# EasyEDA Pro project Q's HelloWorld KeyBoard.eprj, schematic SCH 主体功能板

## Sheets
1 P1: Create Date: 2022-10-02; Page Name: P1; Project Name: Q's HelloWorld KeyBoard; Schematic Name: SCH 主体功能板; Update Date: 2022-10-06; Company: 嘉立创EDA; Page Size: A4; Version: V1.0
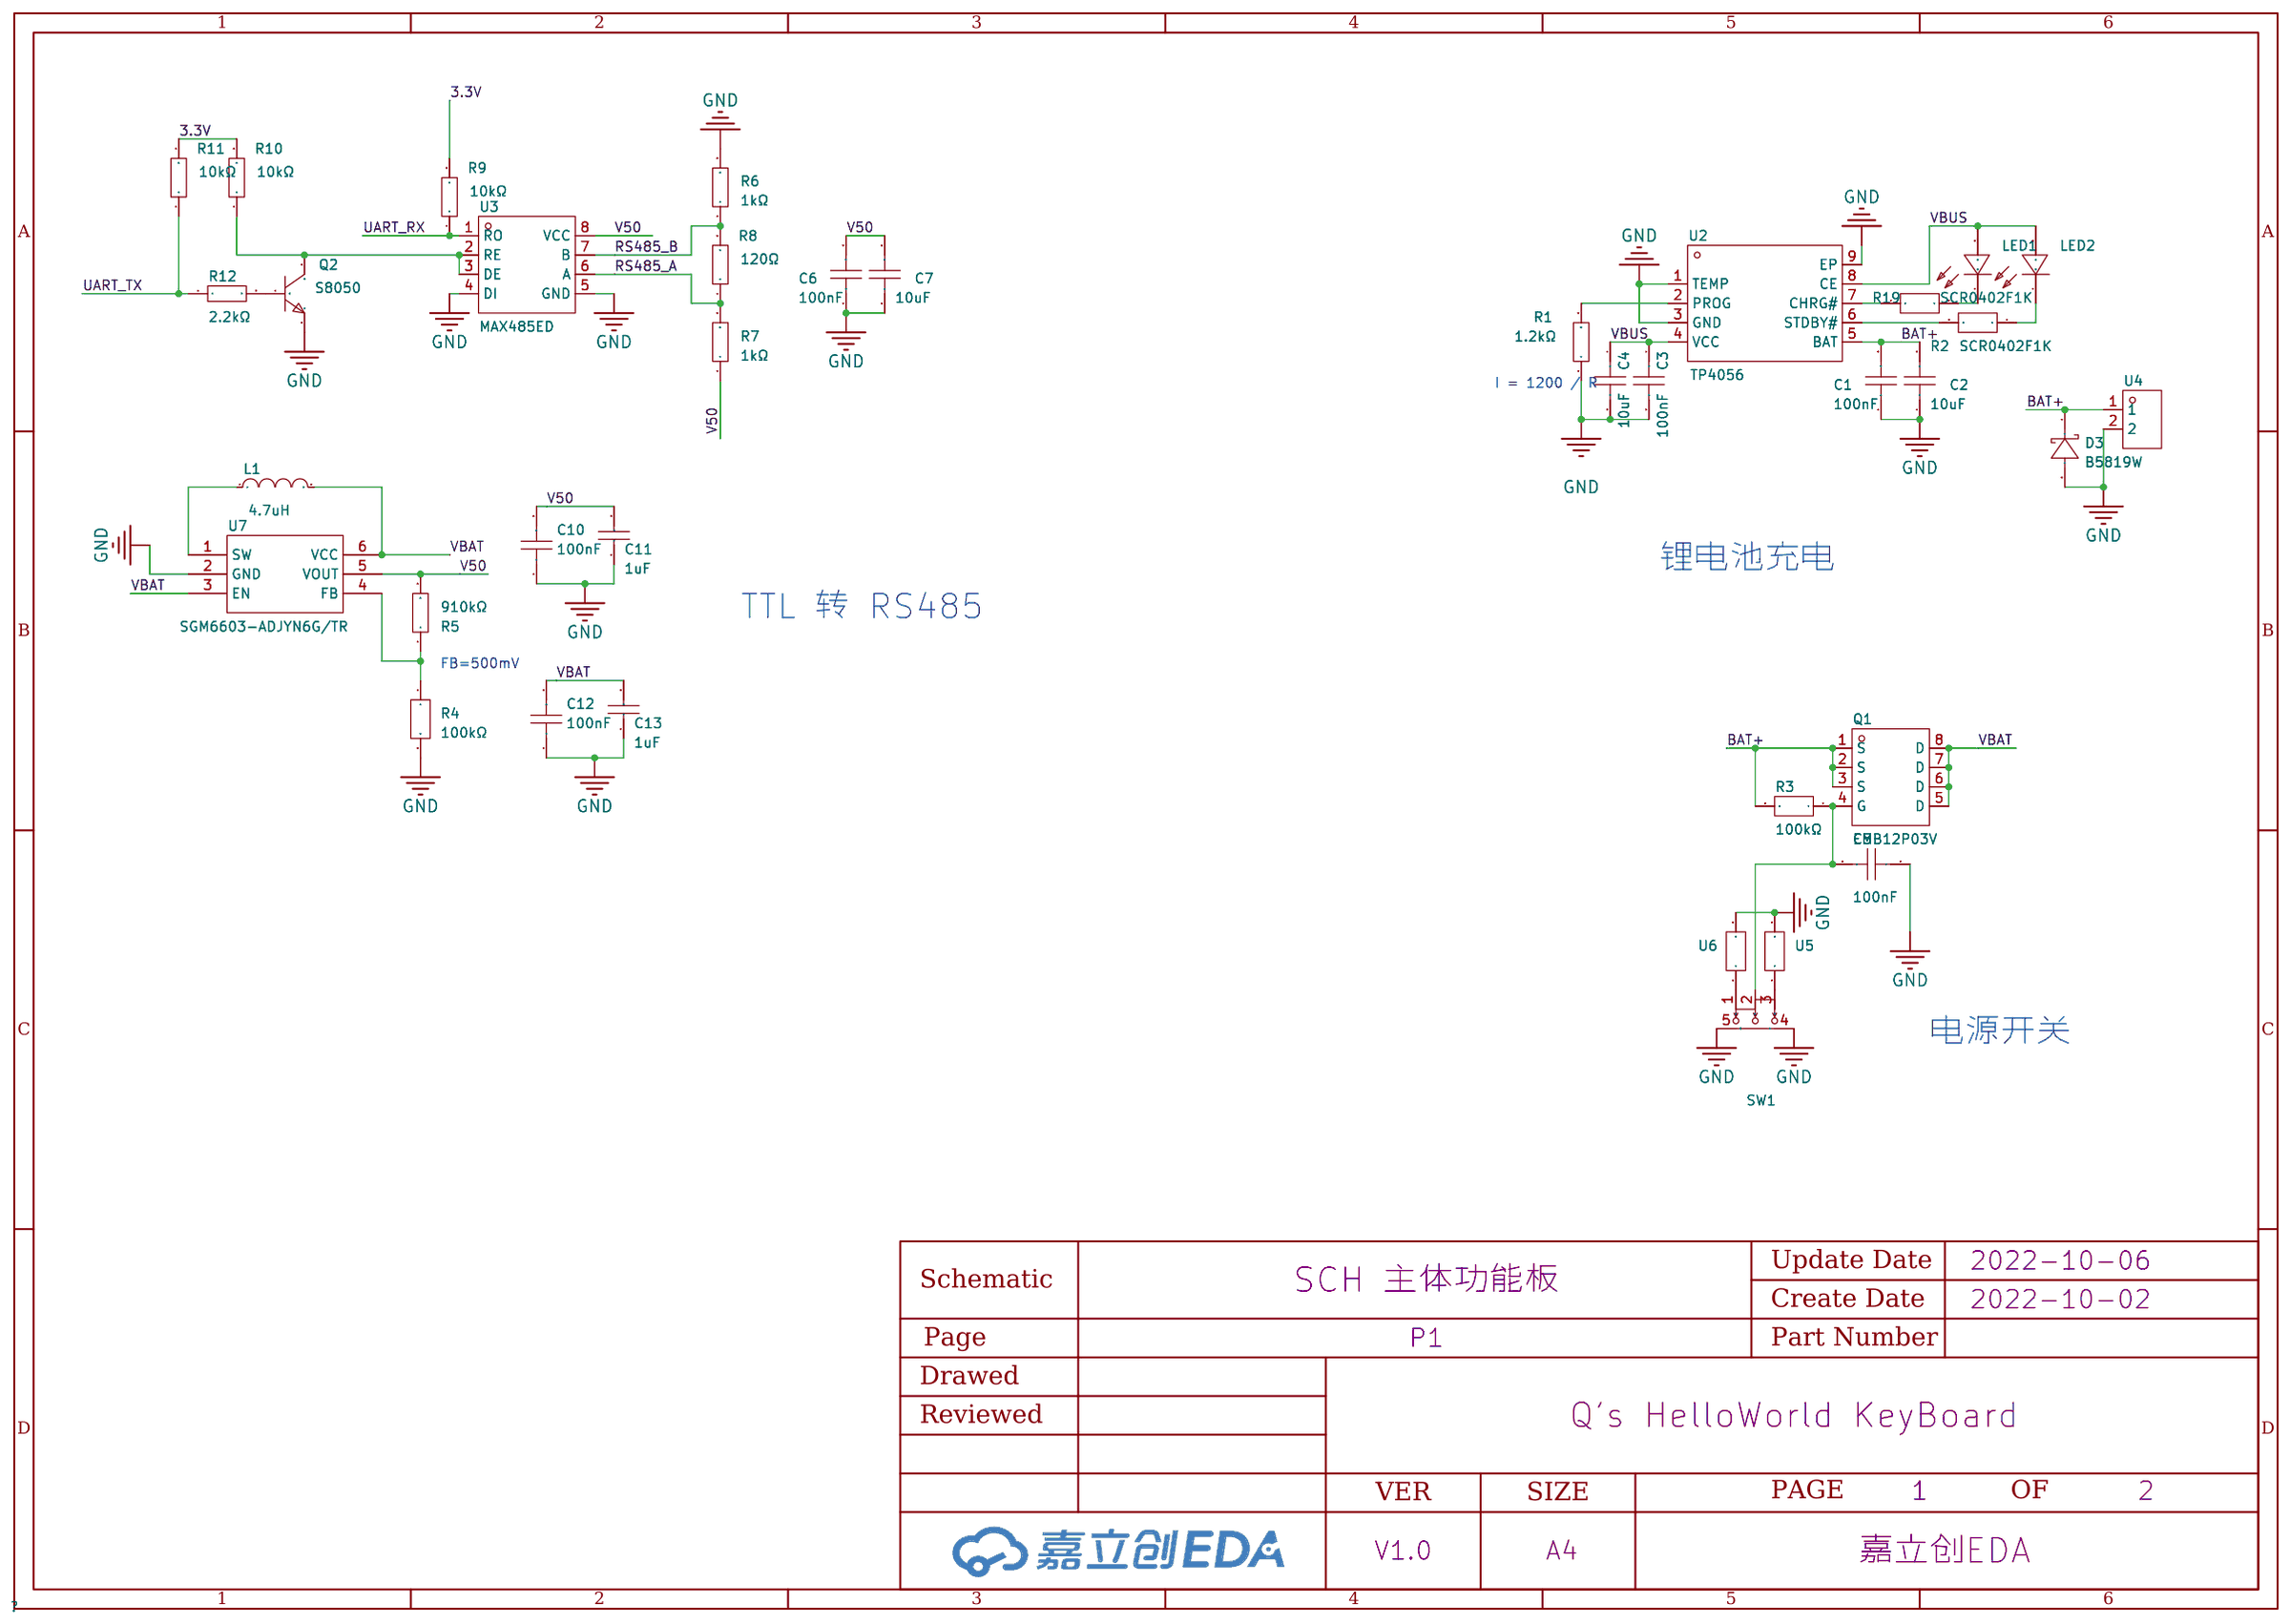
[diagram p2: P1]
2 P2 USB Hub: Page Name: P2 USB Hub; Update Date: 2022-10-05; Page Size: A3
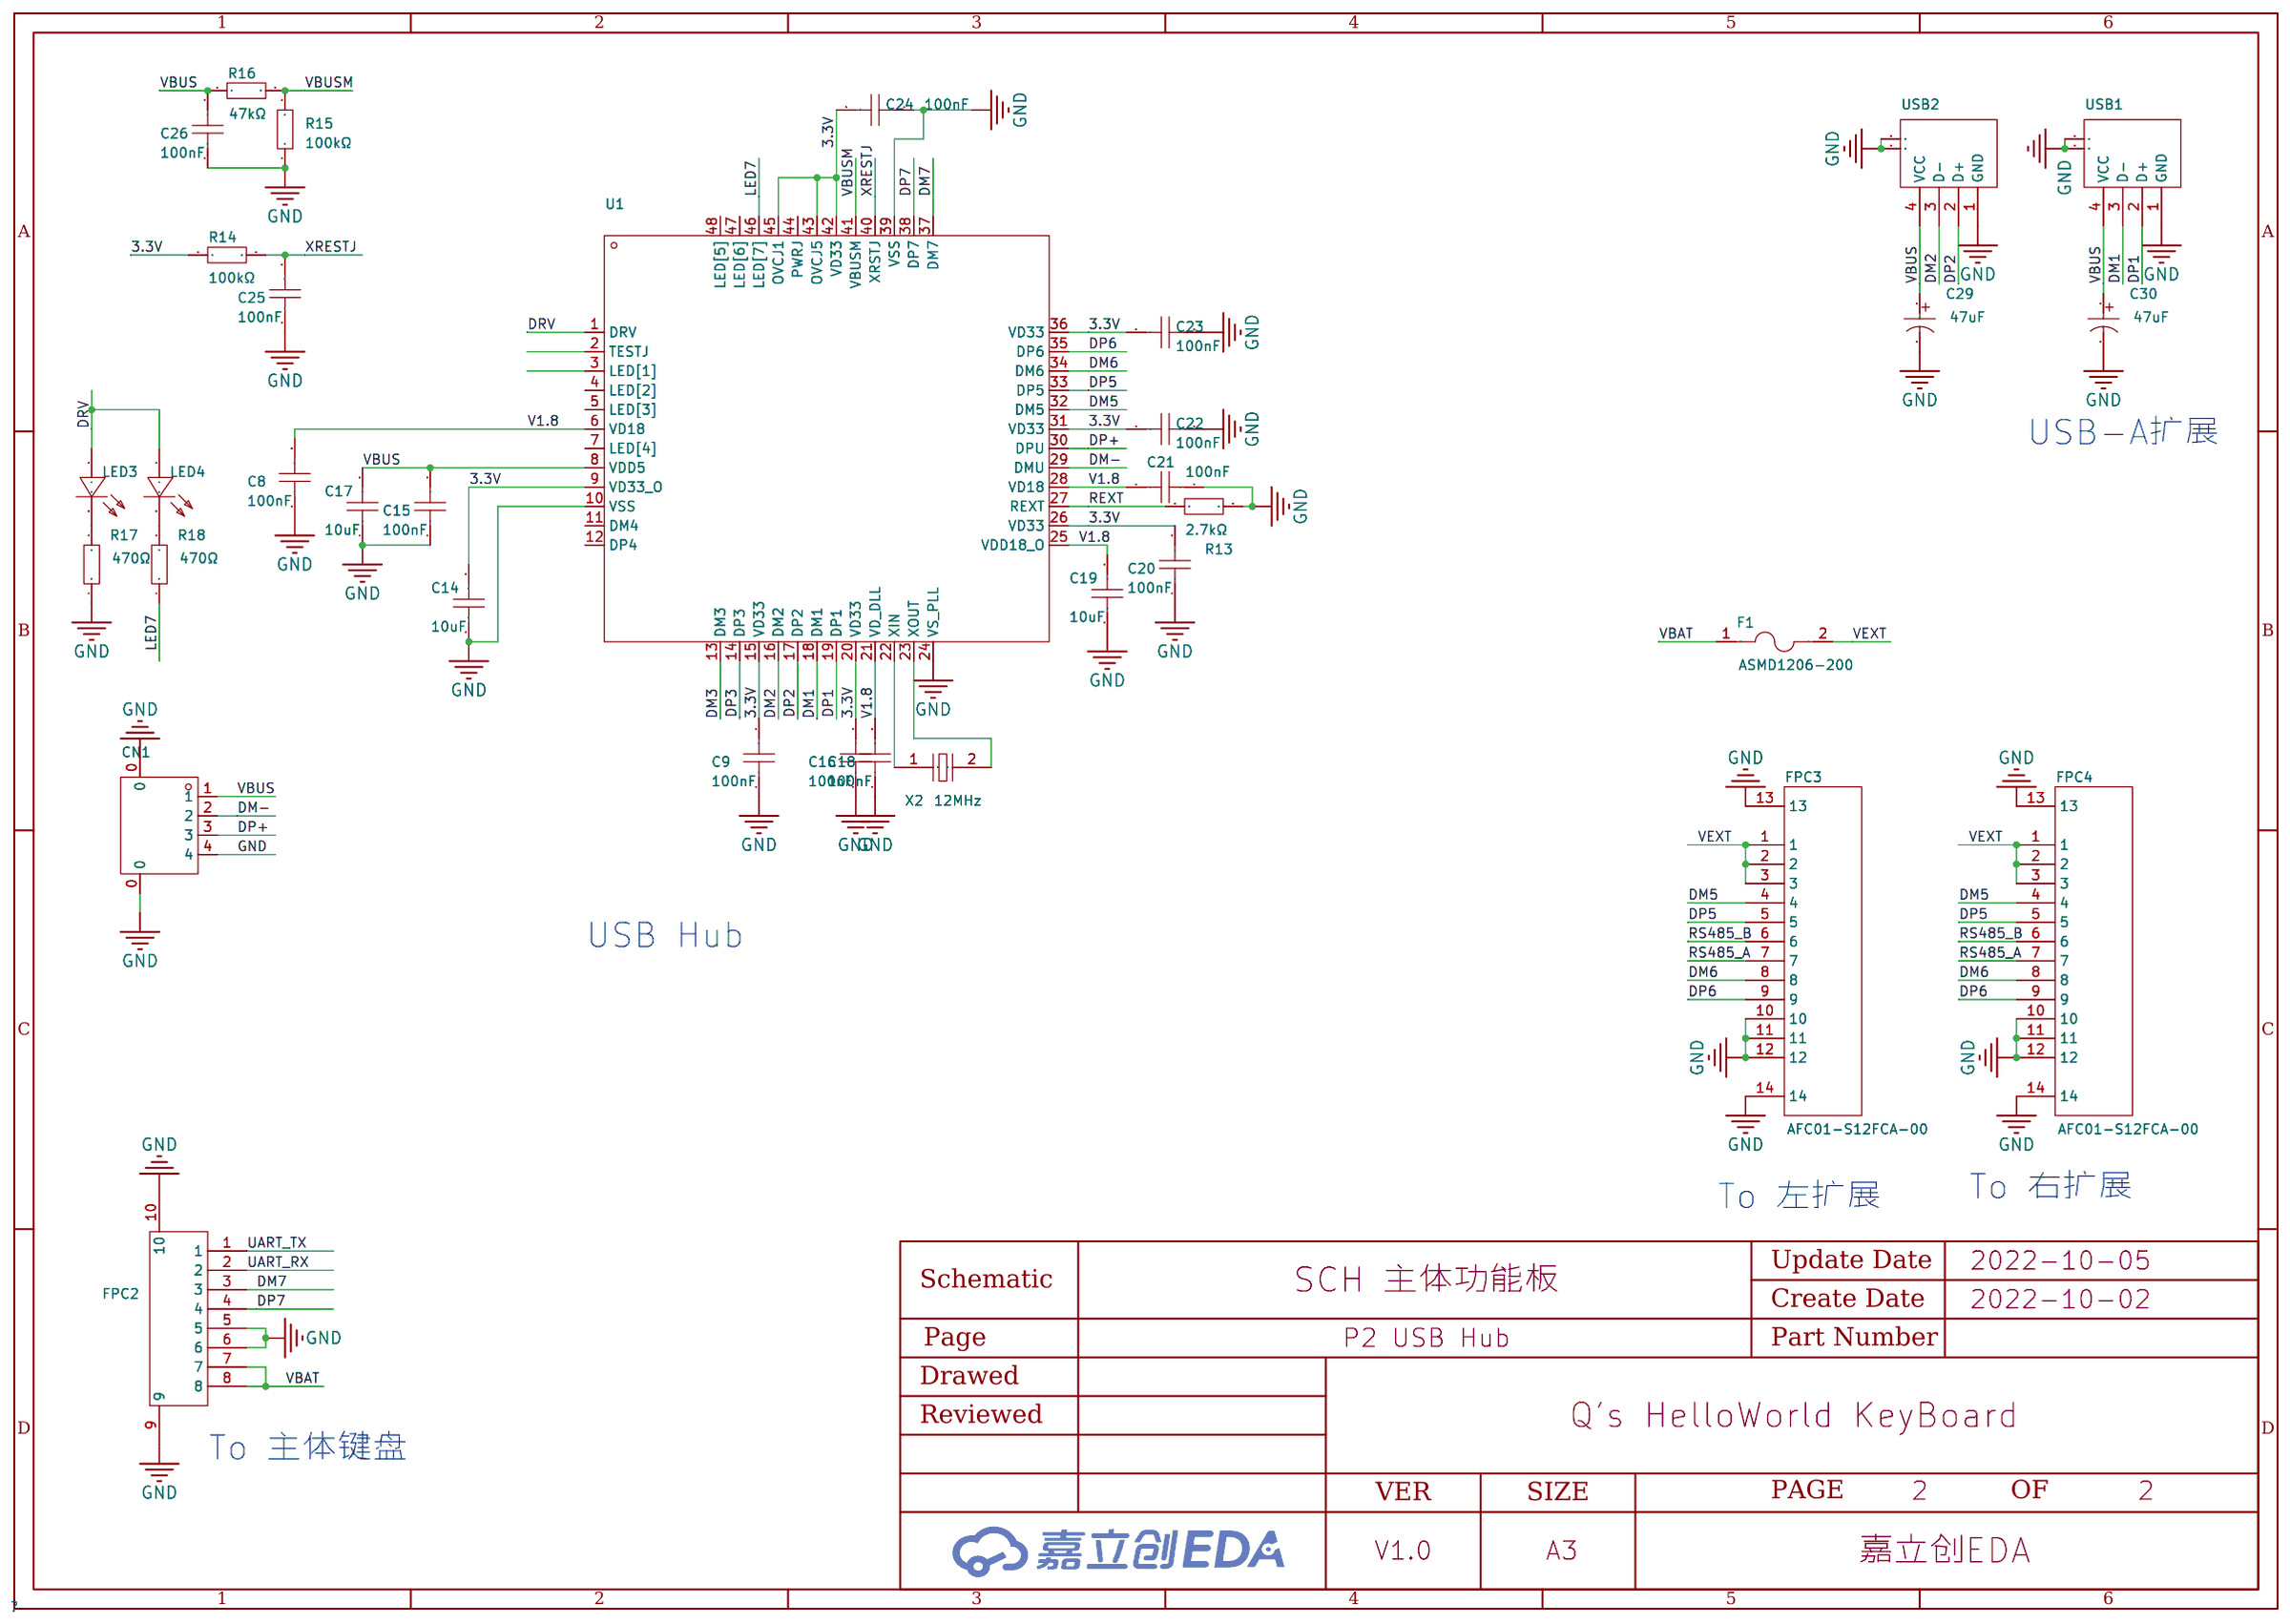
[diagram p3: P2 USB Hub]

## Parts
sheet P1
C1  100nF  [C0402]
C2  10uF  [C0603]
C3  100nF  [C0402]
C4  10uF  [C0603]
C5  100nF  [C0402]
C6  100nF  [C0402]
C7  10uF  [C0603]
C10  100nF  [C0402]
C11  1uF  [C0402]
C12  100nF  [C0402]
C13  1uF  [C0402]
D3  B5819W  [SOD-123_L2.7-W1.6-LS3.7-RD-1]
L1  4.7uH  [IND-SMD_L4.4-W4.2]
LED1  TLMS1100-GS08  [LED0603-RD_RED]
LED2  TLMS1100-GS08  [LED0603-RD_RED]
Q1  EMB12P03V  [POWERTDFN-8_L3.1-W3.1-P0.65-LS3.3-BL]
Q2  S8050  [SOT-23-3_L2.9-W1.3-P1.90-LS2.4-BR]
R1  1.2kΩ  [R0402]
R2  SCR0402F1K  [R0402]
R3  100kΩ  [R0402]
R4  100kΩ  [R0402]
R5  910kΩ  [R0402]
R6  1kΩ  [R0402]
R7  1kΩ  [R0402]
R8  120Ω  [R0402]
R9  10kΩ  [R0402]
R10  10kΩ  [R0402]
R11  10kΩ  [R0402]
R12  2.2kΩ  [R0402]
R19  SCR0402F1K  [R0402]
SW1  SK-12D07-VG3  [SW-TH_SK-12D07-VG3]
U2  TP4056  [ESOP-8_L4.9-W3.9-P1.27-LS6.0-BL-EP]
U3  MAX485ED  [SOP-8_L4.9-W3.9-P1.27-LS6.0-BL]
U4  电池盒接口  [TH_C9900019910]
U5  0Ω_0402_±10%  [R0402]
U6  0Ω_0402_±10%  [R0402]
U7  SGM6603-ADJYN6G/TR  [SOT-23-6_L2.9-W1.6-P0.95-LS2.8-BR]
sheet P2 USB Hub
C8  100nF  [C0402]
C9  100nF  [C0402]
C14  10uF  [C0603]
C15  100nF  [C0402]
C16  100nF  [C0402]
C17  10uF  [C0603]
C18  100nF  [C0402]
C19  10uF  [C0603]
C20  100nF  [C0402]
C21  100nF  [C0402]
C22  100nF  [C0402]
C23  100nF  [C0402]
C24  100nF  [C0402]
C25  100nF  [C0402]
C26  100nF  [C0402]
C29  47uF  [CAP-SMD_BD5.0-L5.3-W5.3-RD]
C30  47uF  [CAP-SMD_BD5.0-L5.3-W5.3-RD]
CN1  1.0T-4P卧贴  [CONN-SMD_1.0T-4P]
F1  ASMD1206-200  [F1206]
FPC2  -  [FPC-SMD_P0.50-8P_FGS-XJ-H2.0]
FPC3  AFC01-S12FCA-00  [FPC-SMD_AFC01-S12FCA-00]
FPC4  AFC01-S12FCA-00  [FPC-SMD_AFC01-S12FCA-00]
LED3  TJ-S1608SW6TGLC7K-A5  [LED0603-R-RD]
LED4  TJ-S1608SW6TGLC7K-A5  [LED0603-R-RD]
R13  2.7kΩ  [R0402]
R14  100kΩ  [R0402]
R15  100kΩ  [R0402]
R16  47kΩ  [R0402]
R17  470Ω  [R0402]
R18  470Ω  [R0402]
U1  FE2.1  [LQFP-48_L7.0-W7.0-P0.50-LS9.0-BL]
USB1  904-241A2032S10100  [USB-A-SMD_USB-M-32]
USB2  904-241A2032S10100  [USB-A-SMD_USB-M-32]
X2  12MHz  [HC-49S_L11.4-W4.5-LS12.7]

## Library data of the parts
C1 C3 C5 C6 C8-C10 C12 C15 C16 C18 C20-C26 = GCM155R71C104KA55J: 容值:100nF;精度:±10%;额定电压:-;材质(温度系数):-;; LCSC Part Name: 100nF ±10%; Supplier Part: C2655418; Manufacturer: muRata(村田); Supplier Footprint: 0402; JLCPCB Part Class: Extended Part; Datasheet: https://atta.szlcsc.com/upload/public/pdf/source/20210701/42090801FDE37D0E45AFF657247F4A08.pdf; Supplier: LCSC; Tolerance: ±10%
C2 C4 C7 C14 C17 C19 = GRM188C81A106KA73D: 容值:10uF;精度:±10%;额定电压:-;材质(温度系数):-;; LCSC Part Name: 10uF ±10%; Supplier Part: C385036; Manufacturer: muRata(村田); Supplier Footprint: 0603; JLCPCB Part Class: Extended Part; Datasheet: https://atta.szlcsc.com/upload/public/pdf/source/20191220/C385036_14D8A38EE4E7ED3C8308778725CCABFB.pdf; Supplier: LCSC; Tolerance: ±10%
C11 C13 = CL05A105KP5NNNC: 容值:1uF;精度:±10%;额定电压:10V;材质(温度系数):X5R;; LCSC Part Name: 1uF ±10% 10V; Supplier Part: C14445; Manufacturer: SAMSUNG(三星); Supplier Footprint: 0402; JLCPCB Part Class: Extended Part; Datasheet: https://atta.szlcsc.com/upload/public/pdf/source/20160103/1457707670698.pdf; Supplier: LCSC; Tolerance: ±10%; Voltage Rated: 10V; Temperature Coefficient: X5R
D3 = B5819W: LCSC Part Name: 肖特基二极管; Supplier Part: C779771; Manufacturer: ZRE(治润); Supplier Footprint: SOD-123; JLCPCB Part Class: Extended Part; Datasheet: https://atta.szlcsc.comnull; Supplier: LCSC
L1 = SLO0420H4R7MTT: 精度:±20%;额定电流:-;电感值:4.7uH;直流电阻(DCR):-;; LCSC Part Name: 4.7uH ±20% 2.2A; Supplier Part: C207830; Manufacturer: Sunltech(韩国顺磁); Supplier Footprint: SMD; JLCPCB Part Class: Extended Part; Datasheet: https://atta.szlcsc.com/upload/public/pdf/source/20180412/C207830_A1C825C2E74A2C1BA28A5C3108F80D44.pdf; Supplier: LCSC; Height: 2mm; Tolerance: ±20%; Width: 4.2mm; Length: 4.4mm
LED1 LED2 = TLMS1100-GS08: 发光颜色:红灯;; Supplier Part: C266784; Manufacturer: VISHAY(威世); Supplier Footprint: 0603; JLCPCB Part Class: Extended Part; Datasheet: https://atta.szlcsc.com/upload/public/pdf/source/20181008/C266784_DA83D7B059AAF2F8B2E0AECEC66B2294.pdf; Supplier: LCSC; Emitted Color: 红灯
Q1 = EMB12P03V: 类型:P沟道;漏源电压(Vdss):30V;连续漏极电流(Id):21A;功率(Pd):2.5W;导通电阻(RDS(on)@Vgs,Id):12mΩ@10V,13A;阈值电压(Vgs(th)@Id):3V@250uA;; LCSC Part Name: P沟道 30V 21A; Supplier Part: C461961; Manufacturer: EMC(杰力); Supplier Footprint: EDFN(3x3); JLCPCB Part Class: Extended Part; Datasheet: https://atta.szlcsc.com/upload/public/pdf/source/20191122/C461961_5C753ED95CD6C8D583B3B6533D88D95D.pdf; Supplier: LCSC; Type: P沟道; Drain Source Voltage (Vdss): 30V; Continuous Drain Current (Id): 21A; Power Dissipation (Pd): 2.5W; Drain Source On Resistance (RDS(on)@Vgs,Id): 12mΩ@10V,13A; Gate Threshold Voltage (Vgs(th)@Id): 3V@250uA
Q2 = S8050: NPN 25V 500mA 120-400 SOT-23; Supplier Part: C2931719; Manufacturer: Doeshare(德芯); Supplier Footprint: SOT-23; JLCPCB Part Class: Extended Part; Datasheet: https://atta.szlcsc.com/upload/public/pdf/source/20220117/E6D3315E0D6ADDB25840BFFAC039C5C0.pdf; Supplier: LCSC
R1 = RMC04021.2K1%N: 阻值:1.2kΩ;精度:±1%;功率:1/16W;; LCSC Part Name: 1.2kΩ ±1% 1/16W; Supplier Part: C325417; Manufacturer: Tyohm(幸亚电阻); Supplier Footprint: 0402; JLCPCB Part Class: Extended Part; Datasheet: https://atta.szlcsc.com/upload/public/pdf/source/20190115/C325417_409AC40D895120D91632A8F7538CECBE.pdf; Supplier: LCSC; Tolerance: ±1%; Power(Watts): 1/16W
R2 R19 = SCR0402F1K: LCSC Part Name: SCR0402  ±1%  1K; Supplier Part: C3015791; Manufacturer: VO(翔胜); Supplier Footprint: 0402; JLCPCB Part Class: Extended Part; Datasheet: https://atta.szlcsc.com/upload/public/pdf/source/20220513/247AF9639BA21CF93567DC289CCC6A22.pdf; Supplier: LCSC
R3 R4 = CRCW0402100KJNED: 电阻类型:-;阻值:100kΩ;精度:±5%;功率:63mW;温度系数:±200ppm/K;最大工作电压:75V;工作温度范围:-55~+155;; LCSC Part Name: 100kΩ ±5%; Supplier Part: C482245; Manufacturer: VISHAY(威世); Supplier Footprint: 0402; JLCPCB Part Class: Extended Part; Datasheet: https://atta.szlcsc.com/upload/public/pdf/source/20200618/C481956_E25174B008CE8C884BEDD7D4D15E674F.pdf; Supplier: LCSC; Tolerance: ±5%; Power(Watts): 63mW; Temperature Coefficient: ±200ppm/K; Overload Voltage (Max): 75V; Operating Temperature Range: -55~+155
R5 = RK73H1ETTP9103F: 阻值:910kΩ;精度:±1%;功率:100mW;温度系数:±100ppm/;最大工作电压:75V;工作温度范围:-55~+155;; LCSC Part Name: 910kΩ ±1%; Supplier Part: C316889; Manufacturer: KOA; Supplier Footprint: 0402; JLCPCB Part Class: Extended Part; Datasheet: https://atta.szlcsc.com/upload/public/pdf/source/20190108/C316889_40D2E5009DAF6A661931AEB21BFB9050.pdf; Supplier: LCSC; Tolerance: ±1%; Power(Watts): 100mW; Temperature Coefficient: ±100ppm/; Overload Voltage (Max): 75V; Operating Temperature Range: -55~+155
R6 R7 = 0402WGF1001TCE: 电阻类型:厚膜电阻;阻值:1kΩ;精度:±1%;功率:62.5mW;温度系数:±100ppm/;最大工作电压:50V;工作温度范围:-55~+155;; LCSC Part Name: 1kΩ ±1% 62.5mW; Supplier Part: C11702; Manufacturer: UNI-ROYAL(厚声); Supplier Footprint: 0402; JLCPCB Part Class: Basic Part; Datasheet: https://atta.szlcsc.com/upload/public/pdf/source/20200306/C422600_1E6D84923E4A46A82E41ADD87F860B5C.pdf; Supplier: LCSC; Type: 厚膜电阻; Tolerance: ±1%; Power(Watts): 62.5mW; Temperature Coefficient: ±100ppm/; Overload Voltage (Max): 50V; Operating Temperature Range: -55~+155
R8 = 0402WGF1200TCE: 电阻类型:厚膜电阻;阻值:120Ω;精度:±1%;功率:62.5mW;温度系数:±100ppm/;最大工作电压:50V;工作温度范围:-55~+155;; LCSC Part Name: 120Ω ±1% 62.5mW; Supplier Part: C25079; Manufacturer: UNI-ROYAL(厚声); Supplier Footprint: 0402; JLCPCB Part Class: Basic Part; Datasheet: https://atta.szlcsc.com/upload/public/pdf/source/20200306/C422600_1E6D84923E4A46A82E41ADD87F860B5C.pdf; Supplier: LCSC; Type: 厚膜电阻; Tolerance: ±1%; Power(Watts): 62.5mW; Temperature Coefficient: ±100ppm/; Overload Voltage (Max): 50V; Operating Temperature Range: -55~+155
R9-R11 = RC0402FR-0710KL: 最大工作电压:50V;阻值:10kΩ;工作温度范围:-55~+155;电阻长:-;精度:±1%;电阻直径:-;电阻高:-;电阻宽:-;电阻类型:厚膜电阻;功率:62.5mW;温度系数:±100ppm/;; LCSC Part Name: 10kΩ ±1%; Supplier Part: C60490; Manufacturer: YAGEO(国巨); Supplier Footprint: 0402; JLCPCB Part Class: Extended Part; Datasheet: https://atta.szlcsc.com/upload/public/pdf/source/20170606/1496716515432.pdf; Supplier: LCSC; Overload Voltage (Max): 50V; Operating Temperature Range: -55~+155; Tolerance: ±1%; Type: 厚膜电阻; Power(Watts): 62.5mW; Temperature Coefficient: ±100ppm/
R12 = RC0402FR-072K2L: 电阻类型:厚膜电阻;阻值:2.2kΩ;精度:±1%;功率:62.5mW;温度系数:±100ppm/;最大工作电压:50V;工作温度范围:-55~+155;; LCSC Part Name: 2.2kΩ ±1% 62.5mW; Supplier Part: C114762; Manufacturer: YAGEO(国巨); Supplier Footprint: 0402; JLCPCB Part Class: Extended Part; Datasheet: https://atta.szlcsc.com/upload/public/pdf/source/20170912/C114762_1505207818772963480.pdf; Supplier: LCSC; Type: 厚膜电阻; Tolerance: ±1%; Power(Watts): 62.5mW; Temperature Coefficient: ±100ppm/; Overload Voltage (Max): 50V; Operating Temperature Range: -55~+155
SW1 = SK-12D07-VG3: LCSC Part Name: 拨动开关8.6*4.4*4.8mm; Supplier Part: C521448; Manufacturer: USAKRO(美韩); Supplier Footprint: 插件; JLCPCB Part Class: Extended Part; Datasheet: https://atta.szlcsc.com/upload/public/pdf/source/20200424/C521448_70E86DB8A93351D8749E58BE55870BED.pdf; Supplier: LCSC
U2 = TP4056_C382139: LCSC Part Name: 1A锂电池充电IC; Supplier Part: C382139; Manufacturer: TPOWER(天源); Supplier Footprint: ESOP-8; JLCPCB Part Class: Extended Part; Datasheet: https://atta.szlcsc.com/upload/public/pdf/source/20190327/C382139_EC85960E6FE3E26856C240C81751A184.pdf; Supplier: LCSC
U3 = MAX485ED: 类型:-;协议类别:-;驱动器/接收器数:-;数据速率:-;; Supplier Part: C481667; Manufacturer: HTC; Supplier Footprint: SOP-8; JLCPCB Part Class: Extended Part; Datasheet: https://atta.szlcsc.com/upload/public/pdf/source/20200113/C481667_86CA12344B2034BBC3F3085D860BEB7C.pdf; Supplier: LCSC
U4 = 电池盒接口: Supplier Part: C9900019910; Supplier Footprint: 2pin-焊盘; JLCPCB Part Class: Extended Part; Datasheet: https://atta.szlcsc.comnull; Supplier: LCSC
U5 U6 = 0Ω_0402_±10%: Supplier Part: C9900019101; JLCPCB Part Class: Extended Part; Datasheet: https://atta.szlcsc.comnull; Supplier: LCSC
U7 = SGM6603-ADJYN6G/TR: 功能类型:升压型;同步整流:是;输出通道数:1;拓扑结构:升压式;输入电压:0.9V~5.5V;输出电压:2.5V~5.5V;输出电流(最大值):-;开关频率:1.2MHz;; LCSC Part Name: 升压型 Vin=0.9V~5.5V Vout=2.5V~5.5V; Supplier Part: C79688; Manufacturer: SGMICRO(圣邦微); Supplier Footprint: SOT-23-6; JLCPCB Part Class: Extended Part; Datasheet: https://atta.szlcsc.com/upload/public/pdf/source/20170704/1499151376359.pdf; Supplier: LCSC; Function: 升压型; Synchronous Rectification: 是; Number of Outputs: 1; Topology: 升压式; Input Voltage: 0.9V~5.5V; Output Voltage: 2.5V~5.5V; Switching Frequency: 1.2MHz
C29 C30 = CS1C470M-CRD54: 容值:47uF;精度:±20%;额定电压:16V;电容体直径:5mm;电容体长度:5.4mm;纹波电流:-;等效串联电阻:-;工作寿命:1000hrs@105;工作温度:-40~+105;; LCSC Part Name: 47uF ±20% 16V; Supplier Part: C96178; Manufacturer: ST(先科); Supplier Footprint: SMD,5x5.4mm; JLCPCB Part Class: Extended Part; Datasheet: https://atta.szlcsc.com/upload/public/pdf/source/20170705/1499242772362.pdf; Supplier: LCSC; Tolerance: ±20%; Rated Voltage: 16V; φD: 5mm; L: 5.4mm; Lifetime @ Temp: 1000hrs@105; Operating Temperature: -40~+105
CN1 = 1.0T-4P卧贴: 参考系列:SH;间距:1mm;插针结构:1x4P;排数:1;每排PIN数:4;行距:-;安装方式:-;触头材质:磷铜;; LCSC Part Name: 插座 1*4P 卧贴 卧贴; Supplier Part: C145956; Manufacturer: BOOMELE(博穆精密); Supplier Footprint: SMD,P=1mm; JLCPCB Part Class: Extended Part; Datasheet: https://atta.szlcsc.com/upload/public/pdf/source/20171115/C145956_15107293415261120441.pdf; Supplier: LCSC; Reference Series: SH; Pitch: 1mm; Pins Structure: 1x4P; Number of Rows: 1; Number of PINs Per Row: 4; Contact Material: 磷铜
F1 = ASMD1206-200: 最大电压:6V;最大电流:100A;保持电流:2A;跳闸电流:3.5A;消耗功率:800mW;初始态阻值(最小值):18mΩ;跳断后阻值(最大值):80mΩ;最大动作时间:1.5s;工作温度:-40~+85;; LCSC Part Name: 2A 自恢复; Supplier Part: C135342; Manufacturer: JDTfuse集电通; Supplier Footprint: 1206; JLCPCB Part Class: Extended Part; Datasheet: https://atta.szlcsc.com/upload/public/pdf/source/20171014/C135342_15079756528941038413.pdf; Supplier: LCSC; Operating Voltage (Max): 6V; Current Rating (Max): 100A; Hold Current: 2A; Trip Current: 3.5A; Power Dissipation: 800mW; Resistance - Initial (Ri) (Min): 18mΩ; Resistance - Post Trip (R1) (Max): 80mΩ; Maximum Time to Trip: 1.5s; Operating Temperature: -40~+85
FPC2 = AFC01-S08FCA-00: 间距:0.5mm;触点数量:8;锁定特性:翻盖式;安装类型:卧贴;触点类型:下接;; LCSC Part Name: 0.5mm P数:8 翻盖式 下接; Supplier Part: C262657; Manufacturer: JS(钜硕电子); Supplier Footprint: SMD,P=0.5mm; Datasheet: https://atta.szlcsc.com/upload/public/pdf/source/20180814/C262657_E4DDBFDEF95394073062C4B6399AAD54.pdf; Supplier: LCSC; Pitch: 0.5mm; Number of Contacts: 8; Locking Feature: 翻盖式; Mounting Type: 卧贴; Contact Type: 下接; Height Above Board: 2mm; FFC, FCB Thickness: 0.3mm
FPC3 FPC4 = AFC01-S12FCA-00: 间距:0.5mm;触点数量:12;锁定特性:翻盖式;安装类型:卧贴;触点类型:下接;; LCSC Part Name: 0.5mm P数:12 翻盖式 下接; Supplier Part: C262661; Manufacturer: JS(钜硕电子); Supplier Footprint: SMD,P=0.5mm; JLCPCB Part Class: Extended Part; Datasheet: https://atta.szlcsc.com/upload/public/pdf/source/20180810/C262661_216573474FA4FCB7E7D6D6C5859A7896.pdf; Supplier: LCSC; Pitch: 0.5mm; Number of Contacts: 12; Locking Feature: 翻盖式; Mounting Type: 卧贴; Contact Type: 下接; Height Above Board: 2mm; FFC, FCB Thickness: 0.3mm
LED3 LED4 = TJ-S1608SW6TGLC7K-A5: 发光颜色:普绿/黄绿;二极管配置:-;透镜颜色:无色透明;主波长:566nm;峰值波长:573nm;色温:-;光通量(25时):-;测试电流:20mA;正向电压(VF):2.4V;发光强度:80mcd;功率:75mW;发光角度:120°;安装方式:-;工作温度:-40~+80;; LCSC Part Name: TJ-S1608SW6TGLC7K-A5 普绿/黄绿; Supplier Part: C192666; Manufacturer: TOGIALED(台湾统佳); Supplier Footprint: 0603; JLCPCB Part Class: Extended Part; Datasheet: https://atta.szlcsc.com/upload/public/pdf/source/20180604/C192666_0D9BE232F749BD9BFDBD236627050C93.pdf; Supplier: LCSC; Emitted Color: 普绿/黄绿; Lens Color: 无色透明; Dominant Wavelength: 566nm; Peak Wavelength: 573nm; Forward Current: 20mA; Forward Voltage (VF): 2.4V; Luminous Intensity: 80mcd; Power Dissipation: 75mW; Viewing Angle: 120°; Operating Temperature: -40~+80
R13 = RC0402FR-072K7L: 阻值:2.7kΩ;精度:±1%;功率:62.5mW;温度系数:±100ppm/;最大工作电压:50V;工作温度范围:-55~+155;; LCSC Part Name: 2.7kΩ ±1% 62.5mW; Supplier Part: C138017; Manufacturer: YAGEO(国巨); Supplier Footprint: 0402; JLCPCB Part Class: Extended Part; Datasheet: https://atta.szlcsc.com/upload/public/pdf/source/20171107/C138017_15100516423651096944.pdf; Supplier: LCSC; Tolerance: ±1%; Power(Watts): 62.5mW; Temperature Coefficient: ±100ppm/; Overload Voltage (Max): 50V; Operating Temperature Range: -55~+155
R14 R15 = RC0402FR-07100KL: 阻值:100kΩ;精度:±1%;功率:62.5mW;温度系数:±100ppm/;最大工作电压:50V;工作温度范围:-55~+155;; LCSC Part Name: 100kΩ ±1% 62.5mW; Supplier Part: C60491; Manufacturer: YAGEO(国巨); Supplier Footprint: 0402; JLCPCB Part Class: Extended Part; Datasheet: https://atta.szlcsc.com/upload/public/pdf/source/20170518/1495086055123.pdf; Supplier: LCSC; Tolerance: ±1%; Power(Watts): 62.5mW; Temperature Coefficient: ±100ppm/; Overload Voltage (Max): 50V; Operating Temperature Range: -55~+155
R16 = RC-02W4702FT: 阻值:47kΩ;精度:±1%;功率:62.5mW;温度系数:±200ppm/;最大工作电压:50V;工作温度范围:-55~+155;; LCSC Part Name: 47kΩ ±1% 62.5mW; Supplier Part: C286560; Manufacturer: FH(风华); Supplier Footprint: 0402; JLCPCB Part Class: Extended Part; Datasheet: https://atta.szlcsc.com/upload/public/pdf/source/20180928/C286560_BD6B595325C950E64D46B3EA58FB4E6A.pdf; Supplier: LCSC; Tolerance: ±1%; Power(Watts): 62.5mW; Temperature Coefficient: ±200ppm/; Overload Voltage (Max): 50V; Operating Temperature Range: -55~+155
R17 R18 = RC-02W4700FT: 阻值:470Ω;功率:1/16W;精度:±1%;温度系数:±200ppm/;最大工作电压:50V;工作温度范围:-55~+155;; LCSC Part Name: 470Ω(4700) ±1%; Supplier Part: C286559; Manufacturer: FH(风华); Supplier Footprint: 0402; JLCPCB Part Class: Extended Part; Datasheet: https://atta.szlcsc.com/upload/public/pdf/source/20180928/C286559_260A26D8E3B26478907BA9F97D4C28FC.pdf; Supplier: LCSC; Power(Watts): 1/16W; Tolerance: ±1%; Temperature Coefficient: ±200ppm/; Overload Voltage (Max): 50V; Operating Temperature Range: -55~+155
U1 = FE2.1: Supplier Part: C39693; Manufacturer: TERMINUS; Supplier Footprint: LQFP-48_7x7x05P; JLCPCB Part Class: Extended Part; Datasheet: https://atta.szlcsc.com/upload/public/pdf/source/20161108/1478586364000.pdf; Supplier: LCSC
USB1 USB2 = 904-241A2032S10100: 连接器类型:Type-A;标准:USB 2.0;公母:母座;触点数量:4;端口数量:1;安装方式:卧贴;额定电流 - 电源:1.5A;工作温度范围:-35~+85;; LCSC Part Name: Type-A 母座 卧贴 鱼叉脚贴板无边内弹铁壳LCP本色1.2柱; Supplier Part: C42605; Manufacturer: 精拓金; Supplier Footprint: SMD; JLCPCB Part Class: Extended Part; Datasheet: https://atta.szlcsc.com/upload/public/pdf/source/20210301/C42605_10D213F94B53EE17A096008CCC2E330E.pdf; Supplier: LCSC; Connector Type: Type-A; Standard: USB 2.0; Gender: 母座; Number of Contacts: 4; Number of Ports: 1; Mounting Style: 卧贴; Current Rating - Power (Max): 1.5A; Operating Temperature Range: -35~+85
X2 = WTL49M1220: 晶振类型:49SMD;频率:12MHz;频率公差:±30ppm;频率稳定度:±30ppm;负载电容:20pF;等效串联电阻(ESR):50Ω;工作温度:-20~+70;; LCSC Part Name: 12MHz ±30ppm 20pF; Supplier Part: C2857626; Manufacturer: WTL(维拓); Supplier Footprint: HC-49S-SMD-2P; JLCPCB Part Class: Extended Part; Datasheet: https://atta.szlcsc.com/upload/public/pdf/source/20210826/490F22AEBCC29B044391BD0B701438E5.pdf; Supplier: LCSC; Crystal Type: 49SMD; Frequency Tolerance: ±30ppm; Frequency Stability: ±30ppm; Load Capacitance: 20pF; Equivalent Series Resistance (ESR): 50Ω; Operating Temperature: -20~+70

## Nets
3.3V: C9.2 C14.2 C16.2 C20.2 C22.2 C23.2 C24.2 R9.2 R10.2 R11.2 R14.1 U1.9(VD33_O) U1.15(VD33) U1.20(VD33) U1.26(VD33) U1.31(VD33) U1.36(VD33) U1.42(VD33) U1.43(OVCJ5) U1.45(OVCJ1)
GND: C1.1 C2.1 C3.2 C4.2 C5.1 C6.1 C7.1 C8.1 C9.1 C10.1 C11.1 C12.1 C13.1 C14.1 C15.1 C16.1 C17.1 C18.1 C19.1 C20.1 C21.1 C22.1 C23.1 C24.1 C25.1 C26.1 C29.2 C30.2 CN1.0 CN1.4 D3.2(A) FPC2.5 FPC2.6 FPC2.9 FPC2.10 FPC3.10 FPC3.11 FPC3.12 FPC3.13 FPC3.14 FPC4.10 FPC4.11 FPC4.12 FPC4.13 FPC4.14 Q2.2(E) R1.1 R4.2 R6.2 R13.2 R15.1 R17.1 SW1.4 SW1.5 U1.10(VSS) U1.24(VS_PLL) U1.39(VSS) U2.1(TEMP) U2.3(GND) U2.9(EP) U3.4(DI) U3.5(GND) U4.2 U5.2 U6.2 U7.2(GND) USB1.1(GND) USB1.5 USB1.6 USB2.1(GND) USB2.5 USB2.6
V1.8: C8.2 C18.2 C19.2 C21.2 U1.6(VD18) U1.21(VD_DLL) U1.25(VDD18_O) U1.28(VD18)
V50: C6.2 C7.2 C10.2 C11.2 R5.2 R7.1 U3.8(VCC) U7.5(VOUT)
VBAT: C12.2 C13.2 F1.1 FPC2.7 FPC2.8 L1.2 Q1.5(D) Q1.6(D) Q1.7(D) Q1.8(D) U7.3(EN) U7.6(VCC)
VBUS: C3.1 C4.1 C15.2 C17.2 C26.2 C29.1 C30.1 CN1.1 LED1.2(A) LED2.2(A) R16.1 U1.8(VDD5) U2.4(VCC) U2.8(CE) USB1.4(VCC) USB2.4(VCC)
VBUSM: R15.2 R16.2 U1.41(VBUSM)
BAT+: C1.2 C2.2 D3.1(K) Q1.1(S) Q1.2(S) Q1.3(S) R3.2 U2.5(BAT) U4.1
DM1: U1.18(DM1) USB1.3(D-)
DM2: U1.16(DM2) USB2.3(D-)
DM3: U1.13(DM3)
DM5: FPC3.4 FPC4.4 U1.32(DM5)
DM6: FPC3.8 FPC4.8 U1.34(DM6)
DM7: FPC2.3 U1.37(DM7)
DM-: CN1.2 U1.29(DMU)
DP1: U1.19(DP1) USB1.2(D+)
DP2: U1.17(DP2) USB2.2(D+)
DP3: U1.14(DP3)
DP5: FPC3.5 FPC4.5 U1.33(DP5)
DP6: FPC3.9 FPC4.9 U1.35(DP6)
DP7: FPC2.4 U1.38(DP7)
DP+: CN1.3 U1.30(DPU)
DRV: LED3.1(A) LED4.1(A) U1.1(DRV)
LED7: R18.1 U1.46(LED[7])
REXT: R13.1 U1.27(REXT)
RS485_A: FPC3.7 FPC4.7 R7.2 R8.1 U3.6(A)
RS485_B: FPC3.6 FPC4.6 R6.1 R8.2 U3.7(B)
UART_RX: FPC2.2 R9.1 U3.1(RO)
UART_TX: FPC2.1 R11.1 R12.1
VEXT: F1.2 FPC3.1 FPC3.2 FPC3.3 FPC4.1 FPC4.2 FPC4.3
XRESTJ: C25.2 R14.2 U1.40(XRSTJ)
$1N4433: R1.2 U2.2(PROG)
$1N5915: R19.2 U2.7(CHRG#)
$1N5940: R2.2 U2.6(STDBY#)
$1N8229: C5.2 Q1.4(G) R3.1 SW1.2
$1N9358: SW1.1 U6.1
$1N9425: SW1.3 U5.1
$1N10707: L1.1 U7.1(SW)
$1N11829: R4.1 R5.1 U7.4(FB)
$1N12103: Q2.3(C) R10.1 U3.2(RE) U3.3(DE)
$1N15264: Q2.1(B) R12.2
$1N22313: LED1.1(C) R19.1
$1N22404: LED2.1(C) R2.1
$2N3720: U1.22(XIN) X2.1
$2N3738: U1.23(XOUT) X2.2(GND)
$2N8906: LED3.2(K) R17.2
$2N9172: LED4.2(K) R18.2

Not connected (* = marked no-connect by the designer): U1 2(TESTJ) 3(LED[1]) 4(LED[2]) 5(LED[3]) 7(LED[4]) 11(DM4) 12(DP4) 44(PWRJ) 47(LED[6]) 48(LED[5])

## Notes on the sheets
sheet 1
- I = 1200 / R
- 锂电池充电
- TTL 转 RS485
- FB=500mV
- 电源开关
sheet 2
- USB-A扩展
- USB Hub
- To 左扩展
- To 右扩展
- To 主体键盘
